# EasyEDA Pro project Zero_PCB_JLCEDA.eprj, board Zero_PCB (continued)
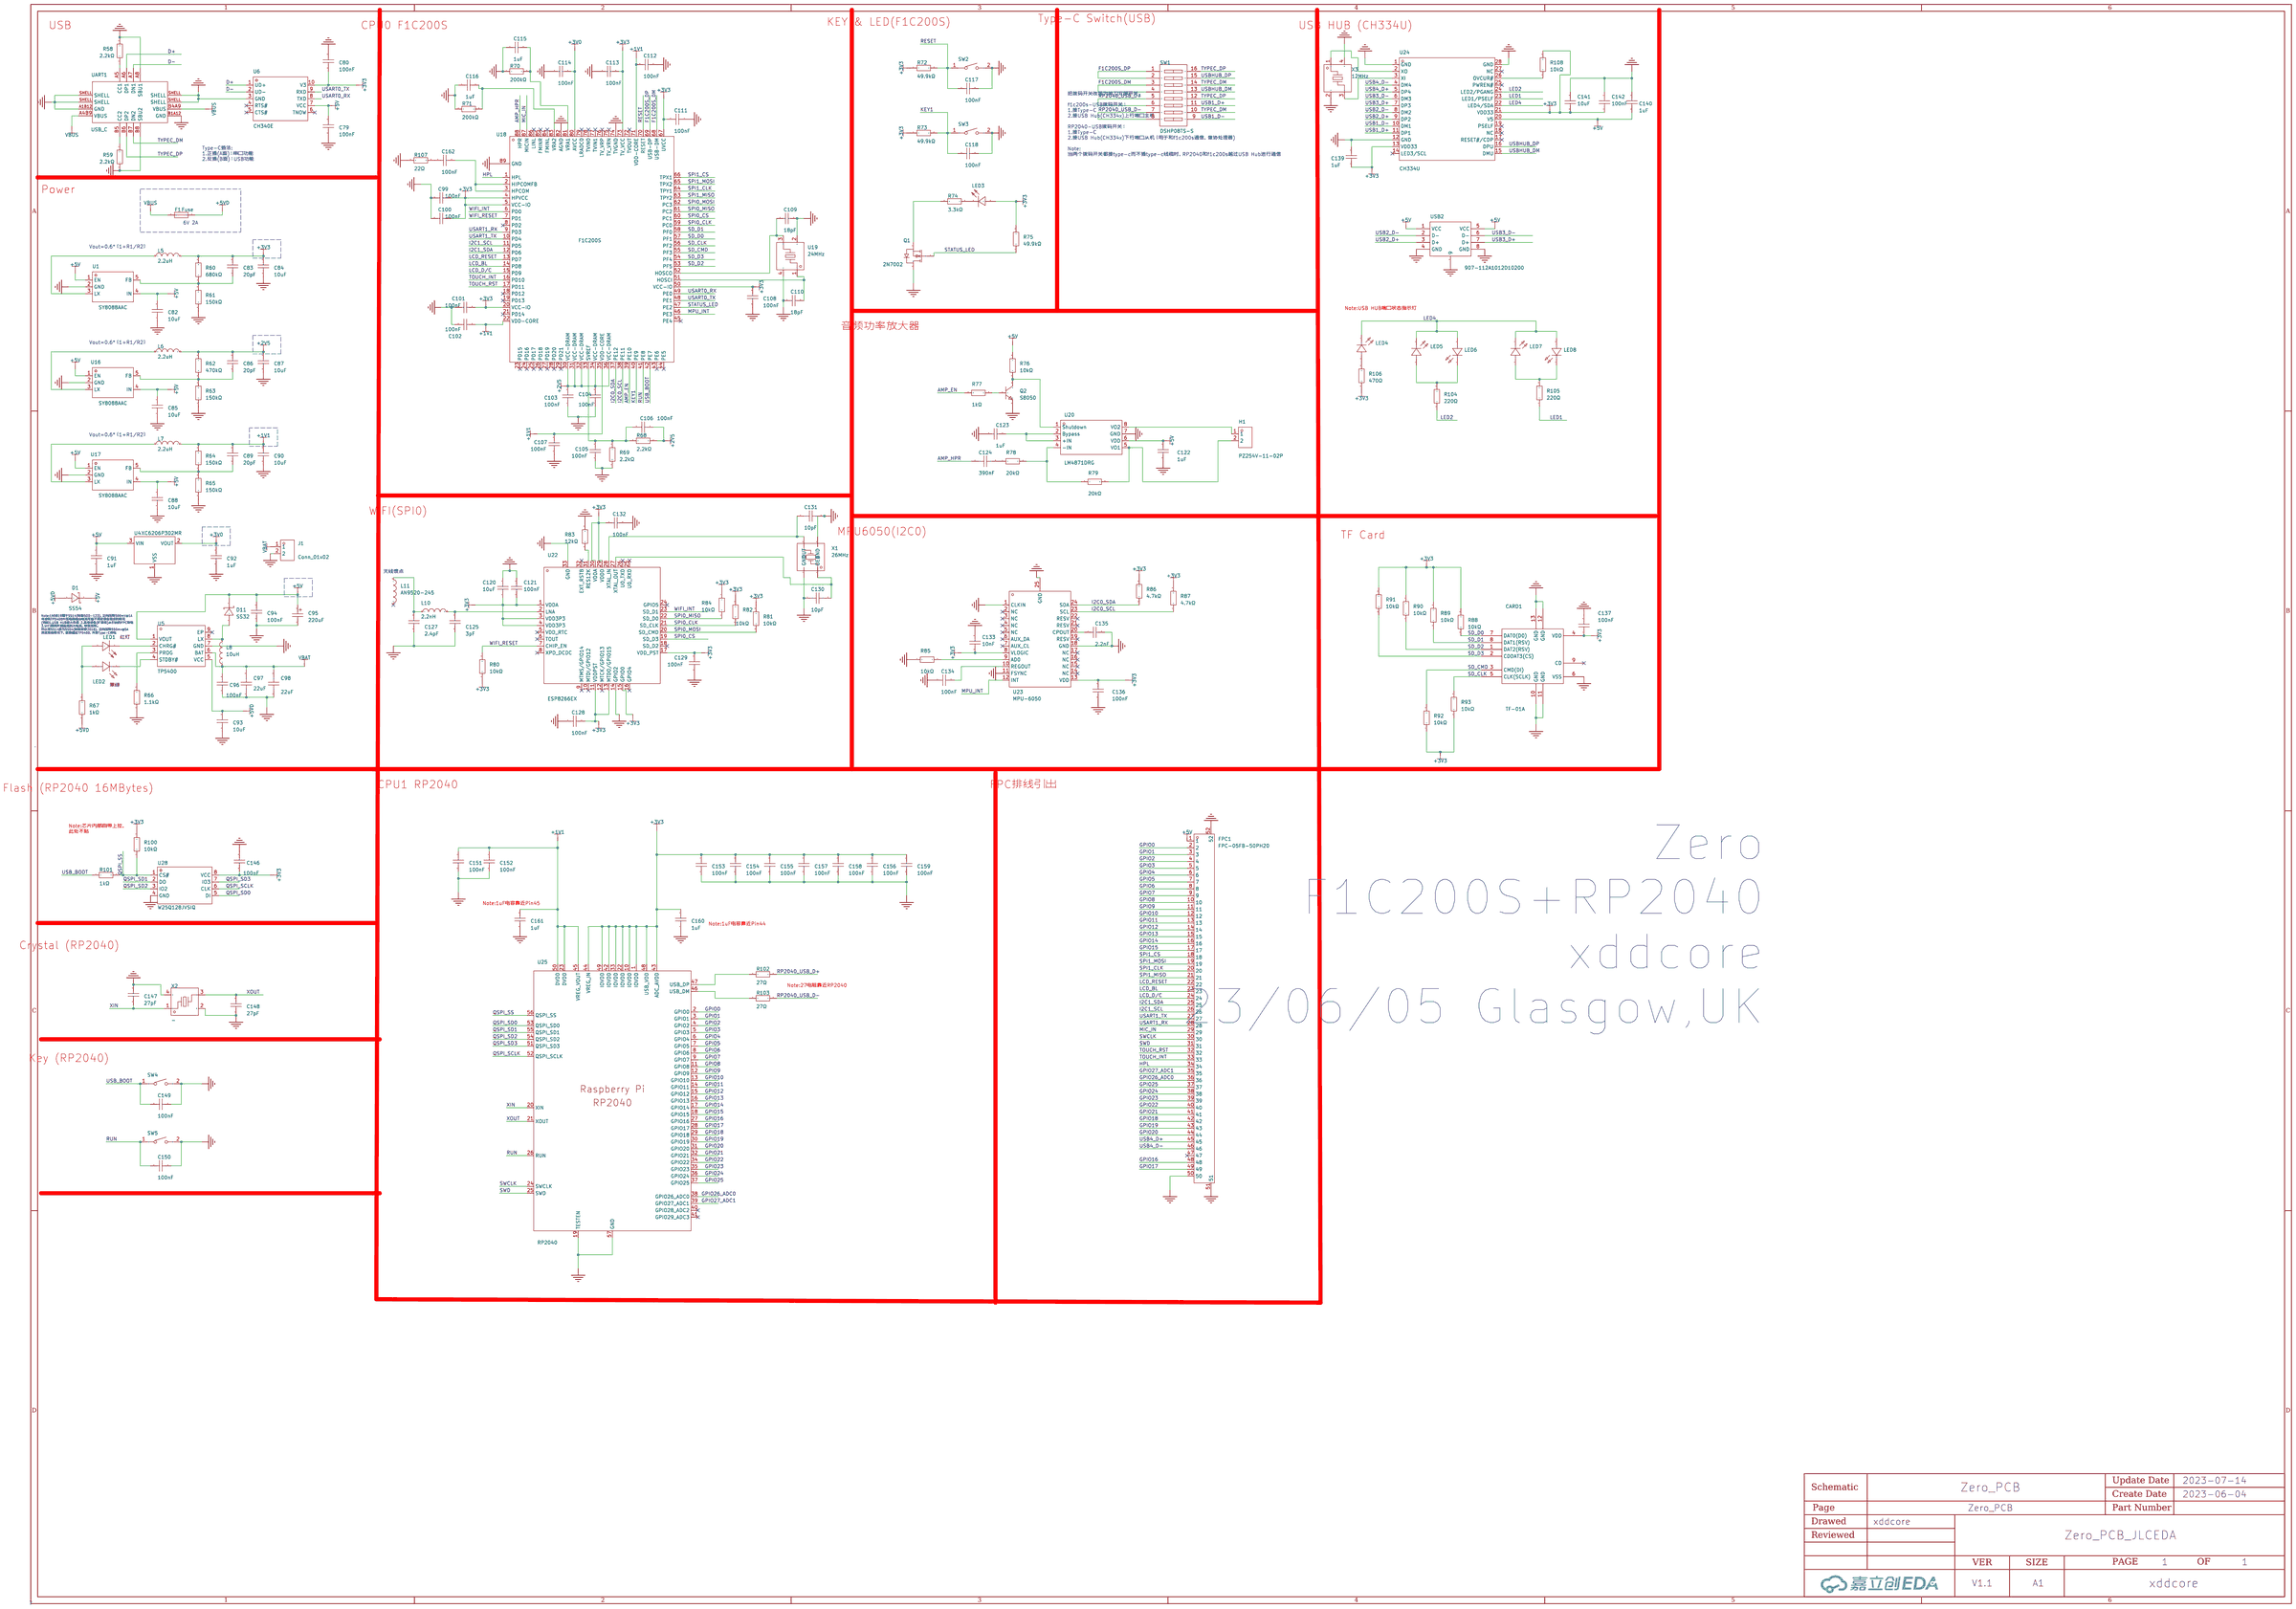
[diagram p0: schematic sheet]
## Routing (per net, layer and track width the routed paths; a pad name or vN(x,y) marks a point on that pad's centre or on a via; arc(x,y) is an arc through that point) (continued)
GPIO20: length 17.5
  Top Layer w0.127: v1(2,28.09) 1.59,27.68 1.59,25.82 1.93,25.48 2.59,25.48
  In1.Cu w0.127: v1(8.68,33.2) 8.68,33.18 8.39,32.89 7.59,32.89 7.1,32.4 7.1,30.46 6.42,29.78 6.43,29.77 6.43,28.66 5.52,27.76 3.84,27.76 3.6,28 2.09,28 v1(2,28.09)
  Bottom Layer w0.127: 7.01,31.3 7.01,32.34 7.46,32.79 8.26,32.79 v1(8.68,33.2)
GPIO21: length 11.7
  Top Layer w0.127: v1(3.57,25.46) 3.59,25.44 3.59,25.42 3.58,25.41 3.58,25.33 3.34,25.09 2.7,25.09
  In1.Cu w0.127: v1(3.57,25.46) 3.57,25.93 4.33,26.69 5.91,26.69 6.19,26.97 6.19,27.28 8.6,29.7 8.6,32.17 v1(8.63,32.2)
  Bottom Layer w0.127: v1(8.63,32.2) 8.63,31.34 8.61,31.33
GPIO22: length 14.2
  Top Layer w0.127: 2.87,24.35 3.32,24.35 3.42,24.45 3.66,24.45 3.71,24.5 3.71,24.92 v1(4.04,25.24)
  In1.Cu w0.127: v1(4.04,25.24) 3.98,25.3 3.98,25.92 4.08,26.02 4.54,26.02 4.76,25.8 4.92,25.8 4.99,25.87 6.29,25.87 6.45,26.03 6.45,27.15 9.03,29.74 9.03,32.48 v1(9.09,32.54)
  Bottom Layer w0.127: 9,31.15 9.09,31.25 v1(9.09,32.54)
GPIO23: length 13.6
  Top Layer w0.127: v1(4.1,24.66) 4.1,24.56 3.75,24.22 3.52,24.22 3.23,23.93 2.65,23.93
  In1.Cu w0.127: v1(9.57,32.26) 9.54,32.23 9.54,29.48 9.21,29.15 8.8,29.15 6.69,27.04 6.69,26.78 6.68,26.77 6.68,25.91 6.41,25.65 5.09,25.65 v1(4.1,24.66)
  Bottom Layer w0.127: 9.58,31.35 9.57,31.36 v1(9.57,32.26)
GPIO24: length 14.8
  Top Layer w0.127: 2.69,23.5 3.37,23.5 v1(3.56,23.69)
  In1.Cu w0.127: v1(3.56,23.69) 4.09,24.22 4.24,24.22 4.49,24.46 4.5,24.46 4.52,24.49 4.52,24.73 5.19,25.4 6.74,25.4 6.92,25.58 6.92,26.95 8.9,28.92 9.49,28.92 9.92,29.35 9.92,31.82 10.12,32.02 v1(10.12,32.26)
  Bottom Layer w0.127: 10.04,31.07 10.12,31.15 v1(10.12,32.26)
GPIO25: length 16.8
  Top Layer w0.127: v1(4.22,23.8) 3.52,23.1 2.85,23.1
  In1.Cu w0.127: v1(4.22,23.8) 4.75,24.33 4.75,24.64 5.28,25.17 6.83,25.17 7.15,25.49 7.15,26.83 8.99,28.67 10.74,28.67 10.87,28.79 10.87,31.89 10.58,32.18 10.58,32.69 v1(10.6,32.71)
  Bottom Layer w0.127: v1(10.6,32.71) 10.6,31.34
GPIO26_ADC0: length 17.1
  Top Layer w0.127: 2.8,22.69 3.74,22.69 v1(3.82,22.77)
  In1.Cu w0.127: v1(3.82,22.77) 4.98,23.94 4.98,24.54 5.38,24.94 7.06,24.94 7.38,25.25 7.38,26.72 9.09,28.44 11.09,28.44 11.35,28.69 11.35,32.06 v1(11.09,32.32)
  Bottom Layer w0.127: v1(11.09,32.32) 11.09,31.27 11.11,31.25
GPIO27_ADC1: length 19.1
  Top Layer w0.127: v1(4.09,22.31) 4.06,22.28 2.72,22.28
  In1.Cu w0.127: v1(4.09,22.31) 5.22,23.44 5.22,24.43 5.47,24.68 7.32,24.68 7.63,24.99 7.63,26.5 9.33,28.2 11.36,28.2 11.86,28.71 11.86,32.56 v1(11.62,32.8)
  Bottom Layer w0.127: v1(11.62,32.8) 11.56,32.74 11.56,31.15
HPL: length 27.1
  Top Layer w0.152: 30.16,43.71 30.69,43.71 31.25,43.15 v2(31.25,43.08)
  In2.Cu w0.152: v2(27.68,39.59) 25.84,39.59 22.45,36.21 17.42,36.21 16.78,36.85 16.08,36.85 14.37,35.14 v2(14.37,33.66)
  Bottom Layer w0.152: 12.12,31.54 12.12,31.99 13.25,33.12 14.05,33.12 14.37,33.43 v2(14.37,33.66) ; v2(27.68,39.59) 31.16,43.08 v2(31.25,43.08)
I2C0_SCL: length 9.7
  Top Layer w0.127: 43.61,32.94 43.61,33.89 43.33,34.18 ; v1(38.85,32.71) 38.52,33.04 38.52,33.27 37.89,33.9 37.05,33.9 37.01,33.93 37.01,34.39
  Bottom Layer w0.127: v1(43.6,33.63) 43.6,33.66 43.35,33.91 42.39,33.91 41.19,32.71 v1(38.85,32.71)
I2C0_SDA: length 10.2
  Top Layer w0.127: 43.1,32.91 42.09,33.92 42.09,34.21 ; 38.3,33.18 37.8,33.67 36.79,33.67 36.56,33.91 36.56,34.61 ; v1(38.29,32.2) 38.29,33.17
  Bottom Layer w0.127: v1(38.29,32.2) 41.26,32.2 v1(42.53,33.47)
I2C1_SCL: length 22
  Top Layer w0.127: 30.37,39.73 30.81,39.73 v1(31,39.92)
  In2.Cu w0.127: v1(18.15,34.4) 18.62,34.87 19.2,34.87 19.32,34.74 29.51,34.74 30.43,35.66 30.43,39.36 v1(31,39.92)
  Bottom Layer w0.127: v1(18.15,34.4) 18.15,33.97 16.11,31.93 16.11,31.39
I2C1_SDA: length 21.4
  Top Layer w0.127: 18.93,34.43 18.95,34.45 v1(18.95,34.46) ; v1(31.11,39.42) 31.05,39.36 30.2,39.36
  In2.Cu w0.127: v1(18.95,34.46) 29.63,34.46 30.75,35.59 30.75,39.06 v1(31.11,39.42)
  Bottom Layer w0.127: v1(18.95,34.46) 18.95,34.21 16.6,31.86 16.6,31.27
KEY1: length 21.8
  Top Layer w0.127: 49.03,47.02 48.09,46.07 48.09,44.04 ; 49.18,44.83 48.39,44.04 48.09,44.04 ; 48.09,44.04 46.9,44.04 ; 46.9,44.04 47.75,43.19 v1(47.77,43.19) ; 46.9,44.04 46.87,44.04 ; 46.9,44.04 SW3.1 ; U18.40 37.78,35.25 38.48,35.95 39.01,35.95 v1(39.38,35.57)
  Bottom Layer w0.127: v1(47.77,43.19) 47.77,42.94 41.72,36.9 40.78,36.9 39.46,35.57 v1(39.38,35.57)
LCD_BL: length 23.9
  Top Layer w0.127: 30.16,38.54 29.65,38.54 29.05,39.13 v1(28.97,39.13)
  In1.Cu w0.127: v1(28.77,33.52) 28.93,33.68 31.02,33.68 31.45,34.12 31.45,37.52 29.85,39.13 v1(28.97,39.13)
  Bottom Layer w0.127: v1(28.77,33.52) 28.59,33.34 21.79,33.34 21.08,34.05 19.8,34.05 17.57,31.81 17.57,31.36
LCD_D/C: length 23.4
  Top Layer w0.127: 30.1,38.13 28.96,38.13 v1(28.84,38.24)
  In1.Cu w0.127: v1(28.84,38.24) 29.34,37.75 30.84,37.75 31.22,37.37 31.22,34.25 30.89,33.92 v1(28.39,33.92)
  Bottom Layer w0.127: 17.04,31.34 17.04,31.83 19.52,34.31 21.2,34.31 21.92,33.58 28.05,33.58 v1(28.39,33.92)
LCD_RESET: length 22
  Top Layer w0.127: v1(31.24,38.89) 30.26,38.89 30.23,38.92
  In1.Cu w0.127: 31.22,38.82 31.3,38.82 31.32,38.83 31.32,38.83 31.73,38.42 31.73,33.93 31.06,33.26 v1(30.17,33.26)
  Bottom Layer w0.127: v1(30.17,33.26) 30,33.09 21.64,33.09 20.92,33.81 20.07,33.81 18,31.74 18,31.28 ; v1(31.24,38.89) 31.22,38.88 31.22,38.82
LED1: length 7.4
  Top Layer w0.127: 37.06,20.05 37.02,20.01 v1(36.44,20.01) ; 36.43,26.81 36.43,25.74
  Bottom Layer w0.127: v1(36.44,20.01) 36.44,20.02 v1(36.44,25.74)
LED2: length 9.7
  Top Layer w0.127: 37.89,18.71 37.89,18.92 37.4,19.42 37.39,19.41 v1(37.38,19.41) ; 35.8,26.91 v1(35.8,25.72)
  Bottom Layer w0.127: v1(35.8,25.72) 35.8,19.93 36.32,19.41 v1(37.38,19.41)
LED4: length 24.2
  Top Layer w0.127: 42.77,18.73 42.76,18.73 ; 42.76,18.73 41.33,18.73 40.05,17.45 ; 42.76,18.73 42.8,18.77 v1(43.31,18.77) ; 42.76,18.73 42.74,18.75 ; 39.91,17.4 38.15,17.4 38.14,17.39 ; 39.91,17.4 39.92,17.4 ; 39.91,17.4 39.65,17.65 39.65,18.34 39.23,18.77 ; 39.91,17.4 39.91,17.37 ; 39.23,18.77 38.72,18.77 38.71,18.76 v1(38.7,18.76) ; 39.23,18.77 39.25,18.77 ; 39.23,18.77 39.22,18.78 ; 37.06,26.86 v1(37.06,25.68) ; 44.56,25.34 v1(44.56,22.47)
  Bottom Layer w0.127: v1(37.06,25.68) 37.06,19.89 37.19,19.76 37.32,19.88 37.5,19.88 38.62,18.76 v1(38.7,18.76) ; v1(43.31,18.77) 43.44,18.77 44.56,19.88 v1(44.56,22.47)
MIC_IN: length 29.5
  Top Layer w0.127: v1(31.87,45.34) 31.57,45.34 31.37,45.14 31.37,44.62 ; v1(16.2,34.35) 16.2,35.89 v1(16.41,36.1)
  Bottom Layer w0.127: 14.53,31.38 14.53,31.83 16.34,33.64 16.34,34.22 v1(16.2,34.35) ; v1(16.41,36.1) 20.63,40.32 20.63,45.67 20.76,45.8 31.41,45.8 v1(31.87,45.34)
MPU_INT: length 11.8
  Top Layer w0.127: U18.46 40.74,35.74 40.91,35.57 v1(40.91,31.64) ; U23.12 45.92,28.59 v1(46.12,28.59)
  Bottom Layer w0.127: v1(46.12,28.59) 43.96,28.59 v1(40.91,31.64)
QSPI_SCLK: length 11.3
  Top Layer w0.127: 7.2,20.22 7.2,20.88 7.03,21.05 v2(7.03,21.5) ; 4.34,14.22 4.35,14.23 v2(7.02,14.23)
  Bottom Layer w0.127: v2(7.02,14.23) 7.03,14.23 v2(7.03,21.5)
QSPI_SD0: length 10.7
  Top Layer w0.127: v2(7.49,15.47) 4.88,15.47 4.71,15.3 ; v2(7.54,21.77) 7.62,21.69 7.62,20.29
  Bottom Layer w0.127: v2(7.49,15.47) 7.48,15.48 7.48,21.7 v2(7.54,21.77)
QSPI_SD1: length 12.2
  Top Layer w0.127: v2(8.54,21.23) 8.52,21.23 8.36,21.08 8.36,20.34 ; v2(8.71,12.93) 11.43,12.93 11.46,12.96
  Bottom Layer w0.127: v2(8.71,12.93) 8.7,12.94 8.7,14.47 8.41,14.76 8.41,21.1 v2(8.54,21.23)
QSPI_SD2: length 11.9
  Top Layer w0.127: v2(8.28,14.27) 11.29,14.27 11.34,14.32 ; v2(8.08,21.6) 8,21.53 8,20.19
  Bottom Layer w0.127: v2(8.08,21.6) 8.08,14.47 v2(8.28,14.27)
QSPI_SD3: length 12.3
  Top Layer w0.127: v2(6.36,21.73) 6.36,21.55 6.68,21.24 6.68,21.02 6.81,20.88 6.81,20.1 6.81,20.1 ; v2(6.03,12.94) 4.24,12.94 4.22,12.93
  Bottom Layer w0.127: v2(6.03,12.94) 6.33,13.25 6.33,21.5 6.32,21.51
QSPI_SS: length 18.3
  Top Layer w0.127: 8.83,20.16 8.86,20.2 v2(10.86,20.2) ; v2(9.15,11.67) 11.41,11.67 11.42,11.66 ; 11.31,11.68 13.26,11.68 R100.1 14.42,11.71 R101.2
  Bottom Layer w0.127: v2(10.86,20.2) 9.82,19.15 9.82,17.02 9.65,16.85 8.84,16.85 8.69,16.71 8.69,14.91 9.15,14.45 v2(9.15,11.67)
RESET: length 9.4
  Top Layer w0.127: U18.70 38.18,45.29 38.37,45.48 v1(38.5,45.48) ; 43.5,44.11 41.71,44.11 41.13,44.68 ; 41.17,46.86 41.84,46.2 41.84,45.42 41.14,44.72 v1(40.53,44.72)
  Bottom Layer w0.127: v1(38.5,45.48) 39.77,45.48 v1(40.53,44.72)
RP2040_USB_D+: length 20.7
  Top Layer w0.127: v1(2.18,13.82) 2.18,14.64 ; v1(1.17,7.43) 1.49,7.43 4.97,3.95 7.49,3.95 8.12,3.32 8.12,1.79 ; SW1.5 SW1.6 v1(9.46,3.19)
  Bottom Layer w0.127: v1(1.17,7.43) 1.18,7.44 1.18,12.82 v1(2.18,13.82)
RP2040_USB_D-: length 21.1
  Top Layer w0.127: R103.2 0.86,8.44 5.09,4.21 9.92,4.21 10.73,3.39 SW1.7 SW1.8
RUN: length 48.2
  Top Layer w0.127: v1(13.16,24.74) 13.16,26.05 13.12,26.08 ; 13.27,26.12 14.93,24.45 14.93,23.75 ; 38.18,34.5 38.18,33.95 39.51,32.61 39.51,31.12 38.03,29.63 33.48,29.63 32.98,29.13 32.98,27.97 31.22,26.21 20.48,26.21 19.92,25.65 18.96,25.65 16.41,23.1 15.31,23.1 14.79,23.62 ; 4.37,27.25 v1(4.37,25.62)
  Bottom Layer w0.127: v1(4.37,25.62) 4.53,25.78 11.65,25.78 12.7,24.74 v1(13.16,24.74)
SD_CLK: length 44.4
  Top Layer w0.127: U18.56 40.7,39.74 40.93,39.51 41.42,39.51 41.92,40.02 v1(42.05,40.02)
  In2.Cu w0.127: v1(42.05,40.02) 41.54,39.51 41.04,39.51 40.27,40.27 37.73,40.27 37.1,39.64 37.1,36.59 35.96,35.45 35.96,35.07 17.79,16.91 14.22,16.91 v1(14.17,16.96)
  Bottom Layer w0.127: 14.17,17.77 v1(14.17,16.96) 14.17,16.29 13.73,15.86
SD_CMD: length 52.4
  Top Layer w0.127: U18.55 40.7,39.34 40.91,39.13 41.04,39.13 41.16,39.26 41.92,39.26 42.43,39.77 v1(42.69,39.77)
  Bottom Layer w0.127: 11.71,17.76 v1(11.71,16.96) 11.71,16.07 11.47,15.83 ; v1(42.69,39.77) 42.43,39.51 40.4,39.51 40.02,39.13 40.02,38.88 20.08,18.94 20.08,14.11 18.88,12.91 12.69,12.91 11.44,14.16 11.44,15.77 CARD1.3
SD_D0: length 42.4
  Top Layer w0.127: v1(41.17,40.07) 41.1,40.14 U18.57
  Bottom Layer w0.127: 15.81,15.87 16.21,16.28 16.21,17.81 ; v1(41.17,40.07) 40.52,40.07 39.67,39.22 39.67,38.91 17.54,16.78 17.54,14.36 17.16,13.98 v1(16.27,13.98) 15.9,14.35 CARD1.7
SD_D1: length 38.7
  Top Layer w0.127: v1(41.54,40.53) 40.2,40.53 U18.58
  In2.Cu w0.127: v1(18.18,18.05) 36.84,36.72 36.84,39.77 37.61,40.53 v1(41.54,40.53)
  Bottom Layer w0.127: 17.47,17.78 17.91,17.78 v1(18.18,18.05) ; 16.99,15.89 16.99,17.19 17.51,17.71
SD_D2: length 50.5
  Top Layer w0.127: v1(9.92,19.81) 9.92,15 v1(9.67,14.75) ; v1(39.26,37.48) 39.26,38.11 39.68,38.54 U18.53
  In2.Cu w0.127: v1(39.26,37.48) 38.75,37.48 36.46,35.19 36.46,33.8 35.96,33.29 35.45,33.29 35.32,33.42 35.19,33.42 17.1,15.32 10.24,15.32 v1(9.67,14.75)
  Bottom Layer w0.127: v1(9.92,19.81) 9.59,19.47 9.59,18.45 8.92,17.78 ; v1(9.67,14.75) 9.3,15.11 CARD1.1
SD_D3: length 44.6
  Top Layer w0.127: U18.54 40.7,38.94 40.89,38.75 v1(41.16,38.75)
  In2.Cu w0.127: v1(41.16,38.75) 37.86,38.75 37.35,38.24 37.35,36.46 36.21,35.32 36.21,34.81 17.92,16.52 10.56,16.52 10.43,16.65 10.43,16.93 v1(10.4,16.96)
  Bottom Layer w0.127: 10.35,17.78 10.4,17.73 v1(10.4,16.96) 10.4,15.92
SPI0_CLK: length 42.5
  Top Layer w0.127: 5.41,32.6 5.41,32.94 v1(5.05,33.3) 5.05,33.31 4.97,33.39 4.97,33.95 ; U18.59 v1(41.04,40.94)
  Bottom Layer w0.127: v1(41.04,40.94) 41.04,40.91 36.75,36.62 28.98,36.62 28.1,35.74 28.1,35.34 27.19,34.43 25.67,34.43 25.24,34.86 14.89,34.86 13.49,33.46 11.46,33.46 11.06,33.86 5.6,33.86 v1(5.05,33.3)
SPI0_CS: length 40.9
  Top Layer w0.127: 3.93,34.08 3.93,34.08 v1(3.93,33.37) ; v1(39.4,41.33) 40.19,41.33 40.19,41.32
  In2.Cu w0.127: v1(3.93,33.37) 3.93,33.13 4.16,32.91 7.13,32.91 7.63,33.42 7.63,33.54 15.42,41.33 v1(39.4,41.33)
SPI0_MISO: length 41.5
  Top Layer w0.127: v1(8.02,33.29) 7.31,32.58 6.6,32.6 ; 5.42,34.04 5.42,33.46 6.29,32.6 6.6,32.6 ; 6.6,32.6 6.64,32.6 ; U18.61 v1(41.04,41.74)
  In2.Cu w0.127: v1(8.02,33.29) 8.02,33.55 15.57,41.1 36.65,41.1 36.84,40.91 40.2,40.91 v1(41.04,41.74)
SPI0_MOSI: length 43.7
  Top Layer w0.127: U18.62 40.14,42.18 v1(39.26,42.18) ; 4.44,34.04 4.44,33.41 v1(4.47,33.38) 4.47,32.8 4.19,32.52
  Bottom Layer w0.127: v1(39.26,42.18) 39,41.92 39,39.77 36.34,37.1 28.21,37.1 27.83,36.72 27.83,35.45 27.07,34.69 25.8,34.69 25.39,35.09 14.76,35.09 13.38,33.7 11.59,33.7 11.19,34.11 5.19,34.11 v1(4.47,33.38)
SPI1_CLK: length 39.2
  Top Layer w0.127: 40.27,42.94 40.79,42.94 40.98,42.75 v1(41.64,42.75)
  In1.Cu w0.127: v1(41.64,42.75) 42.64,42.75 42.94,43.05 44.44,43.05 45.28,42.21 45.28,39.3 45,39.03 42.15,39.03 41.55,39.63 40.73,39.63 40.27,39.17 39.24,39.17 38.96,38.89 38.74,38.89 37.82,37.96 37.82,37.64 37.8,37.62 37.78,37.62 33.63,33.47 v1(32.71,33.47)
  Bottom Layer w0.127: 19.08,31.33 19.08,32.08 19.6,32.6 30.88,32.6 31.27,32.99 31.27,33.06 31.54,33.32 32.14,33.32 32.23,33.22 32.46,33.22 v1(32.71,33.47)
SPI1_CS: length 39.3
  Top Layer w0.127: 40.33,43.73 41.98,43.73 42.33,43.38
  In1.Cu w0.127: v1(31.72,32.3) 33.17,32.3 38.29,37.43 38.29,37.77 38.9,38.37 39.34,38.37 39.64,38.67 40.55,38.67 40.81,38.94 40.81,39.02 40.97,39.17 41.36,39.17 41.99,38.54 45.38,38.54 45.77,38.94 45.77,42.4 44.65,43.52 42.45,43.52 v1(42.32,43.39)
  Bottom Layer w0.127: 20.1,31.49 20.1,31.84 20.37,32.1 31.52,32.1 v1(31.72,32.3)
SPI1_MISO: length 30.1
  Top Layer w0.127: 40.25,42.51 40.93,42.51 v1(41.09,42.35)
  In1.Cu w0.127: v1(32.09,33.75) 32.32,33.98 33.81,33.98 37.59,37.76 37.59,38.08 38.92,39.4 39.75,39.4 40.53,40.18 40.53,41.79 v1(41.09,42.35)
  Bottom Layer w0.127: v1(32.09,33.75) 31.89,33.55 31.44,33.55 31.04,33.15 31.04,33.09 30.8,32.84 21.51,32.84 20.8,33.55 20.39,33.55 19.67,32.84 19.49,32.84 18.56,31.91 18.56,31.32
SPI1_MOSI: length 39.3
  Top Layer w0.127: 40.47,43.32 41.48,43.32 v1(41.53,43.27)
  In1.Cu w0.127: v1(31.67,32.84) 33.34,32.84 38.05,37.55 38.05,37.87 38.83,38.66 39.08,38.66 39.36,38.94 40.49,38.94 40.58,39.03 40.58,39.11 40.87,39.4 41.45,39.4 42.07,38.79 45.16,38.79 45.51,39.13 45.51,42.32 44.54,43.28 42.72,43.28 42.68,43.24 42.68,43.12 42.53,42.97 42.13,42.97 41.84,43.26 41.54,43.26 v1(41.53,43.27)
  Bottom Layer w0.127: 19.57,31.24 19.57,31.95 19.98,32.36 31.07,32.36 31.54,32.84 v1(31.67,32.84)
STATUS_LED: length 10.1
  Top Layer w0.127: Q1.1 45.16,40.65 v1(44.21,40.65) ; 46.64,40.59 45.25,40.59 45.22,40.56 ; U18.47 v1(39.38,36.14)
  Bottom Layer w0.127: v1(44.21,40.65) 42.81,39.26 42.22,39.26 39.38,36.42 v1(39.38,36.14)
SWCLK: length 13
  Top Layer w0.127: 5.2,26.99 5.2,26.45 v1(5.38,26.28)
  Bottom Layer w0.127: 14.04,31.1 14.04,29.96 13.41,29.33 11.94,29.33 11.78,29.16 10.13,29.16 9.97,29 7.8,29 7.08,28.27 5.78,28.27 5.42,27.92 5.42,26.32 v1(5.38,26.28)
SWD: length 13.8
  Top Layer w0.127: v1(4.83,26.29) 4.84,26.29 4.8,26.34 4.8,27.36
  Bottom Layer w0.127: 13.58,31.19 13.55,31.17 13.55,29.83 13.29,29.57 11.86,29.57 11.73,29.44 10.01,29.44 9.79,29.22 7.68,29.22 6.98,28.52 5.13,28.52 5,28.39 5,26.46 v1(4.83,26.29)
TOUCH_INT: length 23.4
  Top Layer w0.152: v2(27.25,38.94) 27.72,38.47 27.72,38.12 28.11,37.73 30.19,37.73
  In2.Cu w0.152: v2(27.25,38.94) 25.64,38.94 22.61,35.91 17.17,35.91 16.58,36.5 16.24,36.5 14.94,35.2 v2(14.94,34.31)
  Bottom Layer w0.152: v2(14.94,34.31) 14.94,34.31 14.94,33.42 14.37,32.86 13.41,32.86 12.59,32.03 12.59,31.31
TOUCH_RST: length 21.9
  Top Layer w0.152: 30.19,37.3 27.91,37.3 27.19,38.02 v2(27.19,38.27)
  In2.Cu w0.152: v2(27.19,38.27) 25.42,38.27 22.63,35.48 21.46,35.48 21.31,35.63 16.46,35.63 15.59,34.76 15.59,34.33 v2(15.59,34.33)
  Bottom Layer w0.152: v2(15.59,34.33) 15.59,33.41 14.78,32.59 13.61,32.59 13.06,32.04 13.06,31.28
TYPEC_DM: length 26.7
  Top Layer w0.127: 9.92,7.63 10.73,8.45 SW1.10 ; 9.92,7.63 6.27,7.63 5.66,8.24 SW1.14 ; 9.92,7.63 13.22,4.33 23.76,4.33 24.28,4.85 UART1.B7
TYPEC_DP: length 30.8
  Top Layer w0.127: v1(25.8,5.22) 25.8,8.05 UART1.B6 ; SW1.16 3.11,10.1 3.82,10.81 7.7,10.81 8.19,10.31 SW1.12 8.78,8.7 v1(8.78,8.14)
  Bottom Layer w0.127: v1(25.8,5.22) 25.03,4.46 20.46,4.46 20.06,4.06 18.57,4.06 18.3,4.33 12.59,4.33 v1(8.78,8.14)
USART0_RX: length 42.8
  Top Layer w0.127: 18.24,6.67 v1(18.24,5.5) ; 40.29,36.96 40.27,36.94 v1(39.33,36.94)
  In1.Cu w0.127: v1(27.26,22.55) 18.24,13.53 v1(18.24,5.5)
  Bottom Layer w0.127: v1(39.33,36.94) 38.99,36.6 38.99,33.52 28.02,22.55 v1(27.26,22.55)
USART0_TX: length 49
  Top Layer w0.127: v1(19.59,7.9) 19.69,7.9 19.69,7.9 ; v1(41.08,36.51) 41.07,36.51 40.11,36.51 ; v1(17.73,7.9) 17.71,7.88 17.71,7.78 17.7,7.76 17.7,6.67
  In1.Cu w0.127: 40.07,22.59 40.07,22.58 ; 40.07,22.59 40.1,22.59 40.38,22.86 40.38,34.01 41.31,34.95 41.31,36.28 v1(41.08,36.51) ; 40.07,22.59 28,22.59 19.59,14.17 v1(19.59,7.9)
  Bottom Layer w0.127: v1(19.59,7.9) v1(17.73,7.9)
USART1_RX: length 21.6
  Top Layer w0.127: v1(29.2,40.53) 30.2,40.53
  In2.Cu w0.127: v1(16.89,34.4) 17.86,35.37 19.48,35.37 19.61,35.23 25.2,35.23 25.96,35.99 27.56,35.99 27.68,36.12 27.68,39.01 v1(29.2,40.53)
  Bottom Layer w0.127: 15.13,31.25 15.13,31.88 16.98,33.73 16.98,34.32 v1(16.89,34.4)
USART1_TX: length 22.3
  Top Layer w0.127: 29.9,40.13 29.6,40.13 29.38,39.91 29.38,39.66 v1(29.22,39.66)
  In2.Cu w0.127: v1(17.47,34.4) 18.17,35.1 19.37,35.1 19.48,35 25.29,35 26.05,35.76 29.76,35.76 30.18,36.19 30.18,38.7 v1(29.22,39.66)
  Bottom Layer w0.127: v1(17.47,34.4) 17.5,34.37 17.5,33.79 15.56,31.85 15.56,31.3
USB1_D+: length 41.5
  Top Layer w0.127: v1(39.6,22.98) 39.6,21.83 ; 9.48,9.43 v1(9.48,10.53)
  Bottom Layer w0.127: v1(39.6,22.98) 39.6,25.05 38.33,26.33 34.3,26.33 18.5,10.53 v1(9.48,10.53)
USB1_D-: length 36.2
  Top Layer w0.127: v1(38.98,22.98) 38.98,21.97 39,21.95 ; 11.98,9.36 v1(11.98,7.96)
  In1.Cu w0.127: v1(11.98,7.96) 11.98,8.86 26.12,22.99 38.97,22.99 v1(38.98,22.98)
USB2_D+: length 27.6
  Top Layer w0.127: U24.9 38.37,21.8 38.37,24.65 37.99,25.03 33.56,25.03 31.89,23.36 31.89,20.72 31.39,20.21 v1(30.52,20.21) ; 34.09,9.61 32.71,9.61 v1(31.26,11.06)
  Bottom Layer w0.127: v1(31.26,11.06) 30.24,12.08 30.24,19.94 v1(30.52,20.21)
USB2_D-: length 28.2
  Top Layer w0.127: v1(33.89,23.89) 33.89,23.89 34.77,24.78 37.81,24.78 38.11,24.48 38.11,23.12 37.7,22.71 U24.8
  Bottom Layer w0.127: v1(33.89,23.89) 33.12,23.89 31.57,22.33 31.57,16.58 31.44,16.45 31.26,16.45 30.47,15.66 30.47,12.42 31.69,11.19 31.69,8.47 32.55,7.61 34.09,7.61
USB3_D+: length 23.5
  Top Layer w0.127: v1(37.61,24.27) 37.07,23.73 U24.7
  Bottom Layer w0.127: USB2.7 36.76,9.54 40.53,9.54 41.67,10.68 41.67,19.06 37.61,23.13 v1(37.61,24.27)
USB3_D-: length 21.5
  Top Layer w0.127: v1(35.15,24.37) 35.62,24.37 36.43,23.56 U24.6
  Bottom Layer w0.127: USB2.6 36.36,7.61 35.57,8.4 35.57,13.35 36.21,13.98 36.21,19.19 35.57,19.83 35.57,23.95 v1(35.15,24.37)
USB4_D+: length 87.5
  Top Layer w0.152: v2(34.63,23.97) 35.59,23.97 35.83,23.72 35.83,21.79
  In2.Cu w0.152: v2(1.79,29.22) 1.03,28.46 1.03,27.45 1.49,26.99 1.49,26.25 0.9,25.67 0.9,17.41 1.67,16.65 2.3,16.65 3.32,15.64 3.32,4.97 3.95,4.33 29.35,4.33 32.05,7.03 v2(32.05,12.82)
  Bottom Layer w0.152: v2(1.79,29.22) 1.79,29.26 2.06,29.53 2.06,31.2 3.39,32.54 6.09,32.54 6.55,32.08 6.55,31.21 ; v2(32.05,12.82) 32.03,12.82 31.63,13.21 31.63,15.76 32.07,16.19 32.07,21.91 33.03,22.87 34.56,22.87 34.94,23.25 34.94,23.76 34.74,23.97 v2(34.63,23.97)
USB4_D-: length 84.5
  Top Layer w0.152: 35.13,21.83 35.13,23.19 34.97,23.35 34.38,23.35 v2(34.28,23.44)
  In2.Cu w0.152: v2(31.01,12.72) 31.76,11.97 31.76,7.51 28.84,4.59 18.56,4.59 17.29,5.86 8.14,5.86 6.87,4.59 4.21,4.59 3.57,5.22 3.57,15.89 2.55,16.91 1.92,16.91 1.28,17.54 1.28,25.16 1.79,25.67 1.79,27.32 1.51,27.6 1.51,28.31 2.79,29.58 v2(2.79,29.88)
  Bottom Layer w0.152: 6.09,31.21 6.09,31.98 5.89,32.17 3.39,32.17 2.46,31.25 2.46,30.23 2.79,29.9 v2(2.79,29.88) ; v2(34.28,23.44) 33.14,23.44 31.81,22.12 31.81,16.45 31.02,15.67 31.02,12.73 v2(31.01,12.72)
USB_BOOT: length 59.6
  Top Layer w0.127: 13.15,29.55 14.34,28.35 v2(14.47,28.35) ; v2(19.6,21.89) 19.6,21.89 19.6,20.73 21.27,19.06 21.5,19.06 ; v1(16.65,11.44) 16.34,11.14 15.85,11.14 ; U18.42 v1(38.58,35.32) ; 13.36,29.47 13.36,30.52 14.75,31.91
  In1.Cu w0.127: v1(26.18,22.37) 26.18,21.79 18.01,13.62 18.01,12.8 v1(16.65,11.44)
  Bottom Layer w0.127: v2(21.5,19.06) 24.8,22.37 v1(26.18,22.37) 26.18,22.49 26.68,23 28.08,23 38.58,33.5 v1(38.58,35.32) ; v2(19.6,21.89) 19.6,22.88 18.15,24.33 16.7,24.33 14.46,26.56 14.46,28.32 14.47,28.33 v2(14.47,28.35)
USBHUB_DM: length 59
  Top Layer w0.127: v1(41.52,25.7) 41.54,25.69 41.54,26.72 41.52,26.74 ; 6.94,9.4 v1(6.94,8.03)
  Bottom Layer w0.127: v1(6.94,8.03) 8.98,10.08 29.73,10.08 33.4,6.42 41.4,6.42 42.02,7.04 42.02,25.2 v1(41.52,25.7)
USBHUB_DP: length 45.3
  Top Layer w0.127: v1(40.82,25.76) 40.82,26.9 ; v1(5.01,10.41) 5.01,9.95 4.4,9.34
  Bottom Layer w0.127: v1(5.01,10.41) 5.01,10.41 8.79,10.41 9.41,11.04 18.5,11.04 34.05,26.59 38.38,26.59 39.21,25.76 40.82,25.76 v1(40.82,25.76)
WIFI_INT: length 30.1
  Top Layer w0.127: v1(31,41.8) 30.24,41.8 U18.6 ; v1(6.97,33.42) 6.88,33.33 6.1,33.33 5.92,33.51 5.92,34.07
  In2.Cu w0.127: v1(31,41.8) 15.34,41.8 v1(6.97,33.42)
WIFI_RESET: length 42.5
  Top Layer w0.127: U22.7 3.44,39.74 v1(3.13,40.05) R80.2 ; U18.7 30.7,41.34 31.13,40.91 v1(31.13,40.53)
  Bottom Layer w0.127: v1(31.13,40.53) 31.51,40.53 31.64,40.4 31.64,37.99 31,37.35 28.08,37.35 27.57,36.84 27.57,35.57 26.94,34.94 25.92,34.94 25.54,35.32 14.62,35.32 13.23,33.93 11.68,33.93 11.28,34.34 4.68,34.34 3.95,35.07 3.95,35.45 3.06,36.34 3.06,39.98 v1(3.13,40.05)
XIN: length 3.8
  Top Layer w0.127: 6.81,27.34 6.81,27.92 7.83,28.94 ; 7.75,28.99 9.38,28.99 9.47,29.08
XOUT: length 7
  Top Layer w0.127: 11.4,30.67 11.23,30.67 v2(10.45,29.89) ; v2(7.12,29.33) 6.8,29.33 6.56,29.1 ; 6.52,28.95 6.52,28.27 6.41,28.15 6.41,27.49
  Bottom Layer w0.127: v2(7.12,29.33) 7.11,29.33 7.32,29.54 9.37,29.54 9.72,29.89 10.44,29.89 v2(10.45,29.89)
$1N21711: length 2
  Top Layer w0.127: R58.1 23.78,9.53 UART1.A5
$1N21714: length 2.2
  Top Layer w0.127: 27.71,10.05 27.71,9.92 26.77,8.99 26.77,8.22
$1N27959: length 1.5
  Top Layer w0.254: L5.1 15.49,21.9 U1.3
$1N28302: length 4.6
  Top Layer w0.254: R60.1 18.69,16.26 17.81,17.14 R61.2 17.6,18.24 U1.5 17.47,18.52 C83.1
$1N28688: length 1.5
  Top Layer w0.254: U16.3 28.16,29.83 L6.1
$1N28696: length 13
  Top Layer w0.254: 31.63,28.59 31.64,28.58 31.64,28.57 ; 31.64,28.57 31.64,27.12 31.15,26.63 26.66,26.63 25.75,27.54 25.13,27.56 ; 31.64,28.57 31.64,28.21 31.36,27.93 29.85,27.93 29.17,28.61 ; 25.13,27.56 25.15,27.56 ; 25.13,27.56 24.22,27.56 24.02,27.36
$1N32220: length 1.8
  Top Layer w0.254: U17.3 18.99,28.08 L7.1
$1N32222: length 8.1
  Top Layer w0.254: 22.68,29.91 22.68,30.24 21.45,31.47 ; 21.5,29.02 22.32,29.84 22.67,29.84 ; v1(22.18,27.6) 22.18,28.23 21.56,28.85 ; v1(22.04,25.82) 21.55,25.32 21.55,24.9
  Bottom Layer w0.254: v1(22.04,25.82) 22.23,26 22.23,27.58 22.2,27.58 v1(22.18,27.6)
$1N51512: length 1.8
  Top Layer w0.127: 28.66,11.13 27.44,12.36 27.4,12.36
$1N51517: length 1.8
  Top Layer w0.127: U5.2 26.02,11.23 LED1.1
$1N51525: length 4.3
  Top Layer w0.127: 29.75,10.57 27.64,10.57 27.11,11.1 ; 29.75,10.57 29.75,9.81 29.8,9.76 ; 29.75,10.57 29.75,11.17
$1N51543: length 2.8
  Top Layer w0.127: U5.3 26.56,11.96 26.56,10.12 R66.2
$1N51674: length 4.1
  Top Layer w0.254: 23.47,18.44 22.96,18.96 22.96,19.52 22.94,19.98 21.31,21.61
$1N53264: length 7.3
  Top Layer w0.127: 35.04,32.75 34.96,32.82 34.96,33.7 ; 35.06,32.6 34.38,31.92 34.38,30.35 34.15,30.13 ; 33.98,32.71 34.96,33.7 ; 34.96,33.7 34.96,34.47 ; 34.15,30.13 35.12,30.13 35.13,30.12 ; 34.15,30.13 33.81,30.13 ; 34.15,30.13 34.15,30.12
$1N53710: length 8.3
  Top Layer w0.127: U18.51 41.24,37.74 v1(41.34,37.64) 42.08,37.64 C110.1 ; 46.66,36.52 46.65,36.53 v1(46.65,37.44)
  In1.Cu w0.127: v1(41.34,37.64) 46.45,37.64 v1(46.65,37.44)
$1N53734: length 5.4
  Top Layer w0.127: 44.76,38.98 44.39,39.36 42.41,39.36 42.13,39.07 42.13,38.76 ; 42.18,38.75 41.56,38.13 40.28,38.13
$1N54438: length 2.5
  Top Layer w0.127: 34.34,46.17 33.77,45.61 ; 33.77,45.61 33.77,44.64 ; 33.77,45.61 33.33,46.05 33.33,46.1
$1N54475: length 3.3
  Top Layer w0.127: 31.92,46.13 33,45.05 33,44.6 ; 31.88,46.25 31.8,46.17 30.63,46.17
$1N55245: length 2.3
  Top Layer w0.127: LED3.2 48.87,41.87 R74.2
$1N55371: length 1.6
  Top Layer w0.127: 46.67,42.74 46.46,42.53 45.16,42.53
$1N57514: length 1.3
  Top Layer w0.127: 23.15,45.2 24.37,45.2 24.39,45.17
$1N57526: length 4.8
  Top Layer w0.127: 26.86,44.23 25.42,42.79 25.42,41.94 ; 25.55,39.98 25.43,40.1 25.43,41.86
$1N57748: length 3.3
  Top Layer w0.127: 23,39.93 23,39.94 ; 23,39.94 24.22,39.94 ; 23,39.94 23,41.97
$1N57804: length 1.5
  Top Layer w0.127: 21.64,44.38 21.64,42.94 21.71,42.86
$1N57843: length 5.1
  Top Layer w0.127: 21.78,39.96 21.78,39.32 20.15,37.68 ; 21.75,42.06 21.75,39.96 21.73,39.94
$1N57974: length 14.8
  Top Layer w0.127: 20.17,36.83 20.11,36.77 ; 20.17,36.83 22.26,38.92 22.26,47.82 ; 20.17,36.83 20.15,36.84 ; 20.17,36.83 21.74,35.25 21.74,34.6
$1N57983: length 13.5
  Top Layer w0.127: v1(25.54,36.21) 25.54,35.67 25.56,35.65 25.56,34.54 ; 25.03,47.84 25.55,47.32 v1(25.55,44.92)
  Bottom Layer w0.127: v1(25.54,36.21) 25.54,44.92 v1(25.55,44.92)
$1N59147: length 3.8
  Top Layer w0.349: 5.93,42.98 5.93,41.78 5.91,41.76 ; 5.93,39.2 5.93,41.76
$1N60101: length 1.6
  Top Layer w0.127: 8.7,39.01 7.55,37.86
$1N60445: length 5.2
  Top Layer w0.127: 11.8,37.22 11.09,36.51 10.11,36.51 ; 10.11,36.5 9.56,35.95 8.45,35.95 8.04,36.36 7.26,36.36
$1N60452: length 7.9
  Top Layer w0.127: 8.92,35.3 8.16,35.3 7.56,35.9 7.26,35.9 ; 13.49,35.06 13.49,34.93 12.55,33.99 9.6,33.99 9.01,34.58 9.01,35.31
$1N60619: length 1.5
  Top Layer w0.127: 44.09,28.81 44.09,28.06 44.6,27.56
$1N60746: length 2.4
  Top Layer w0.127: 46.44,27.64 45.65,27.64 45.12,28.17 44.86,28.17 44.61,28.42 44.61,28.68
$1N60867: length 1.7
  Top Layer w0.127: 45.87,34.34 45.14,33.62 45.14,32.91
$1N62198: length 4.1
  Top Layer w0.152: 33.85,21.58 33.89,21.54 33.89,20.6 34.24,20.25 34.24,18.52 34.1,18.38 33.38,18.38
$1N62206: length 2.1
  Top Layer w0.152: 34.52,21.53 34.52,20.46 35.25,19.74
$1N75896: length 12.1
  Top Layer w0.127: v1(34.53,25.76) 34.53,26.86 34.54,26.87
  Top Layer w0.152: 31.19,17.7 31.18,17.69 v1(31.18,16.93)
  Bottom Layer w0.127: v1(31.18,16.93) 31.18,22.4 v1(34.53,25.76)
$1N77675: length 8.9
  Top Layer w0.127: v2(2.2,16.1) 2.2,15.19 ; 5.19,20.26 5.19,21.33 v2(5,21.51)
  Bottom Layer w0.127: v2(2.2,16.1) 2.2,18.67 4.43,20.9 4.65,20.9 5,21.25 v2(5,21.51)
$1N77680: length 8.8
  Top Layer w0.127: v2(0.91,16.13) 0.91,15.36 ; 4.81,20.27 4.81,21.11 4.61,21.31 v2(4.36,21.31)
  Bottom Layer w0.127: v2(4.36,21.31) 0.91,17.86 v2(0.91,16.13)
$1N78675: length 1.5
  Top Layer w0.127: 45.63,25.37 47.08,25.37 47.1,25.35
$1N78743: length 7.4
  Top Layer w0.127: 40.94,17.44 41.22,17.72 v1(41.22,17.99) ; v1(38.51,19.49) 38.45,19.49 37.81,20.13 ; 40.94,17.4 42.45,17.4 42.63,17.58
  Bottom Layer w0.127: v1(41.22,17.99) 41.22,19.15 40.88,19.49 v1(38.51,19.49)
$1N83735: length 5.1
  Top Layer w0.127: 37.09,18.61 v1(37.09,18.08) 37.09,17.43 37.05,17.39 ; v1(40.15,18.17) 40.27,18.17 40.34,18.24 LED6.1
  Bottom Layer w0.127: v1(37.09,18.08) 37.19,18.17 v1(40.15,18.17)
$1N94983: length 4.2
  Top Layer w0.254: 5.91,48.02 5.92,48.03
  Top Layer w0.349: 5.92,43.86 5.92,45 5.94,45.03 ; 5.91,45.04 5.91,48.02
$1N101606: length 1.7
  Top Layer w0.152: 27.48,45.4 28.46,46.38 28.46,46.66
$1N101653: length 3.5
  Top Layer w0.152: 30.19,43.34 30.17,43.34 ; 30.17,43.34 30.17,43.33 30.17,42.93 ; 30.17,43.34 29.63,43.34 29.31,43.66 29.31,44.63 28.51,45.43 ; 30.17,43.34 30.16,43.35

## Copper pours and planes (outline as drawn; the poured copper is in the pictures)
+5V on In1.Cu: -0.24,49.92 50.18,49.92 50.18,-0.37 -0.24,-0.37
GND on Top Layer: -0.11,49.8 50.05,49.8 50.05,-0.24 -0.11,-0.24
GND on Bottom Layer: -0.49,50.18 50.43,50.18 50.43,-0.62 -0.49,-0.62
GND on In2.Cu: -0.37,50.05 50.31,50.05 50.31,-0.49 -0.37,-0.49

## Text on the board
Bottom Silkscreen Layer: Xddcore / 23/06/07 / Glasgow, UK
Top Silkscreen Layer: Zero Linux Board / F1C200S, RP2040 Inside / V1.1
